# Altium schematic sheet GridSeed Old.SchDoc (part 1 of 2)
size A0
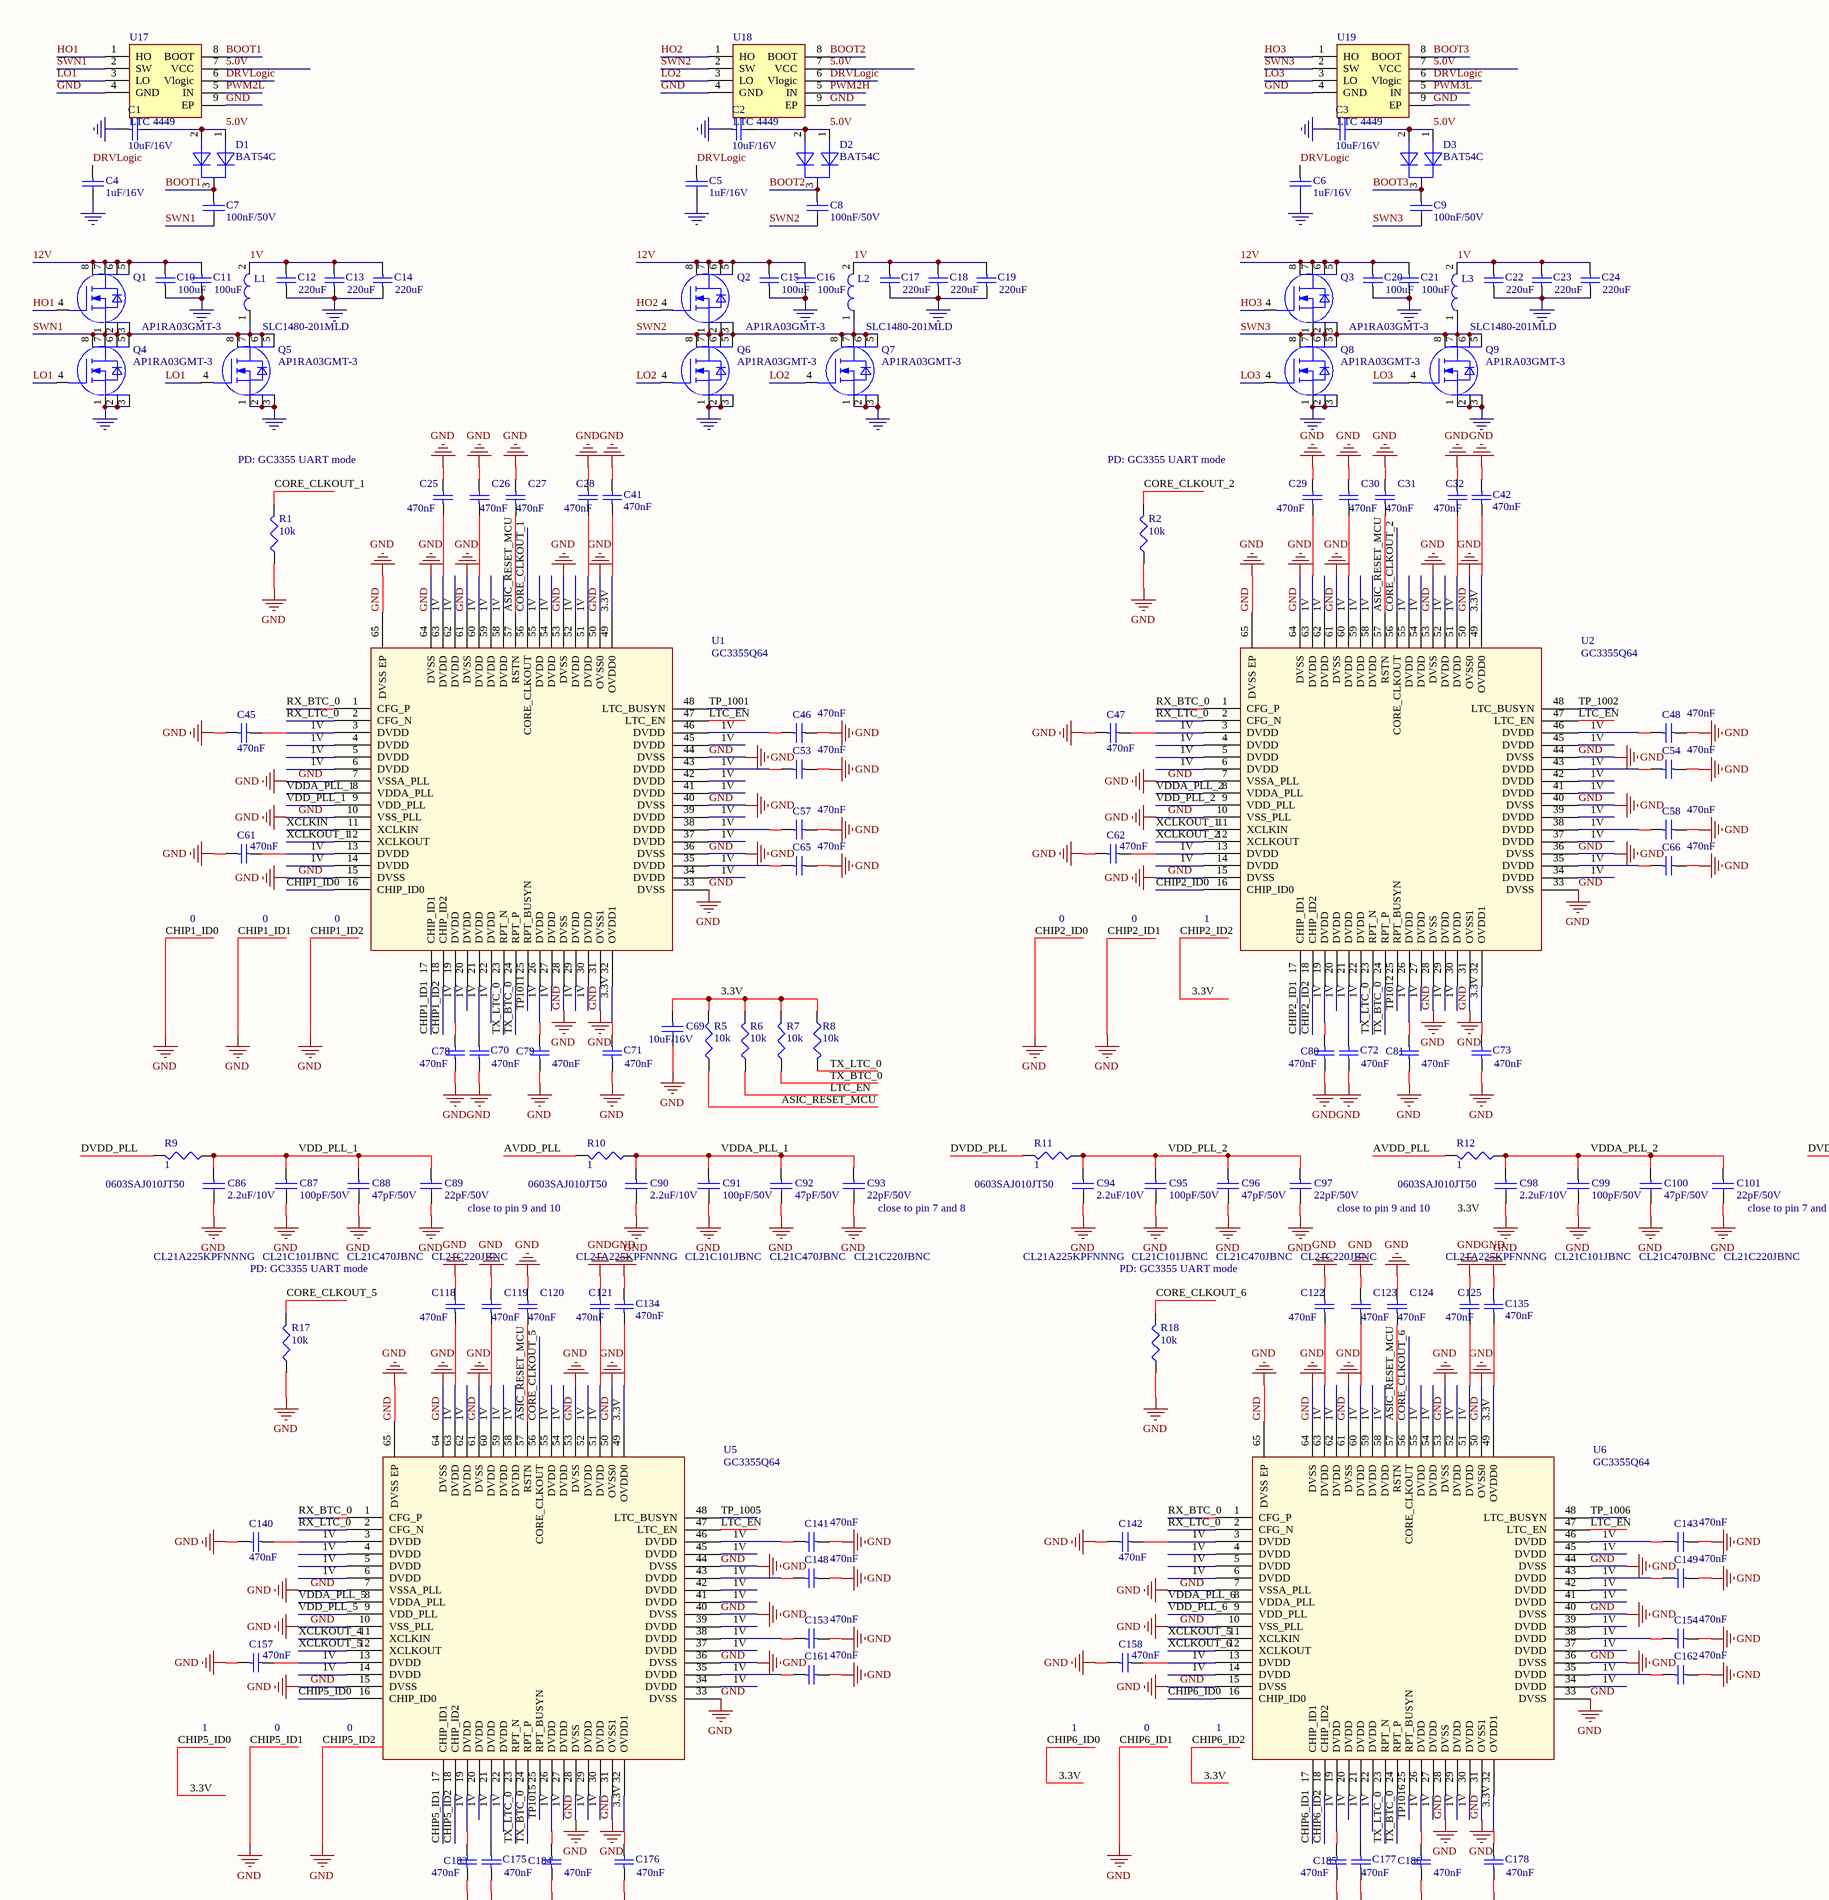
[diagram p0: GridSeed Old.SchDoc, top left]
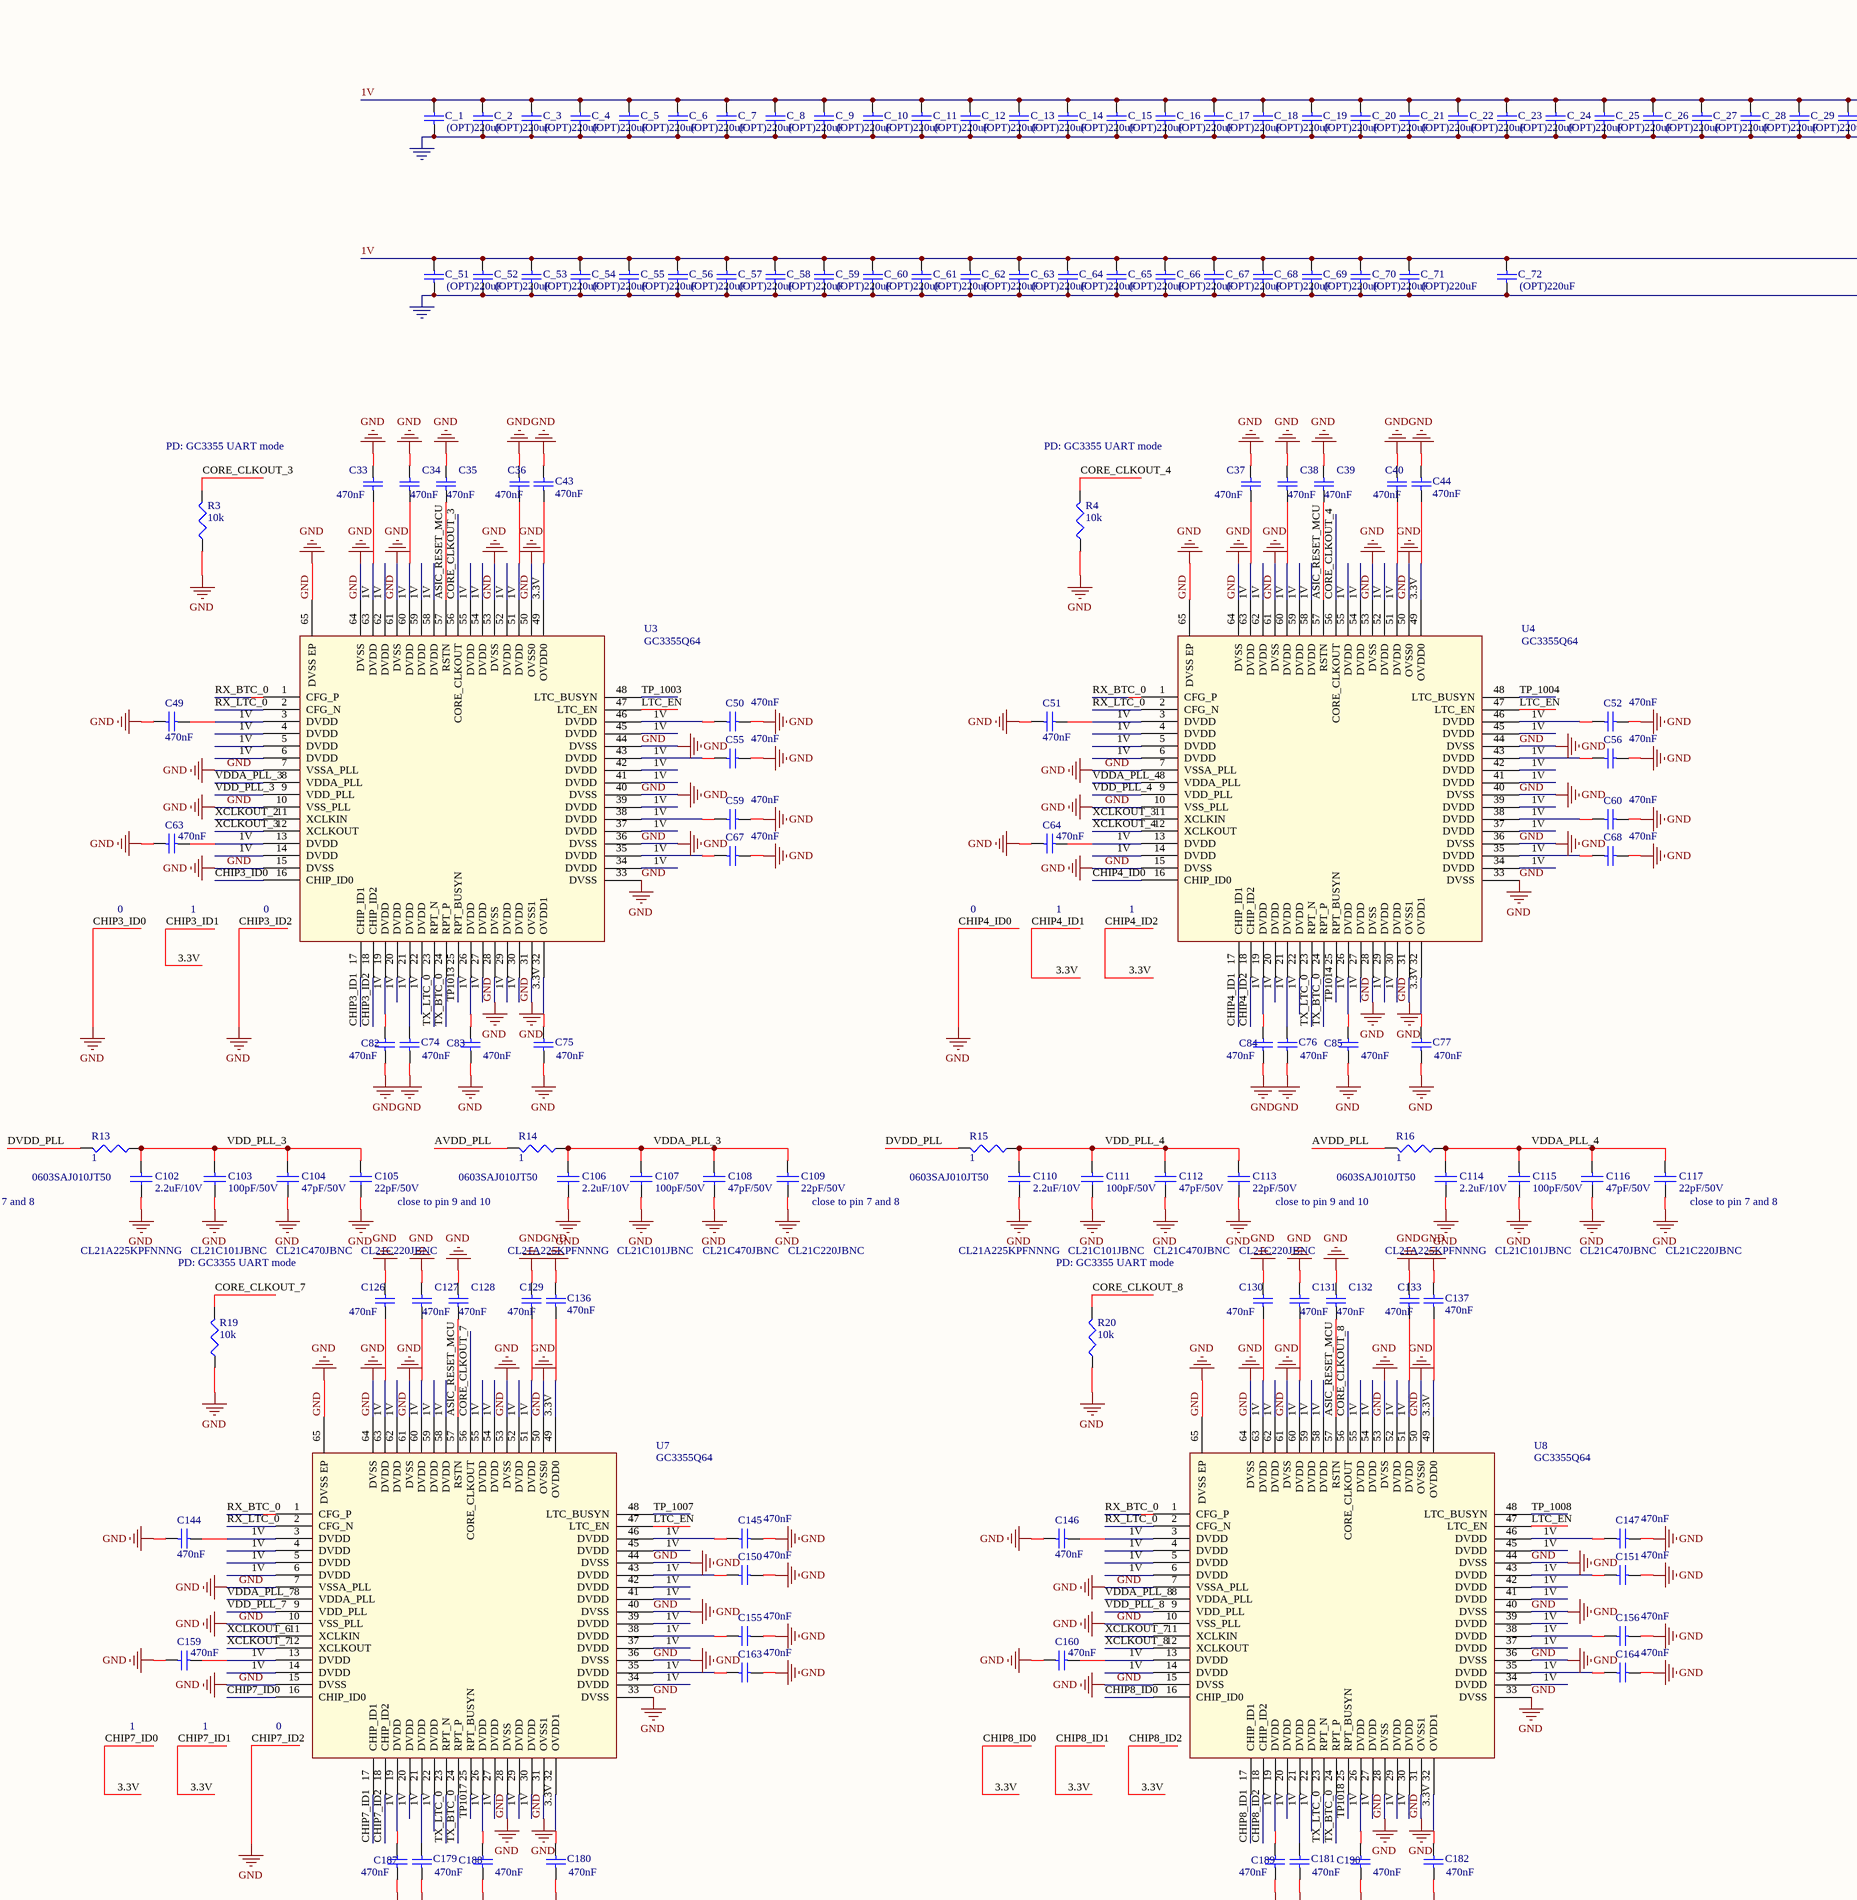
[diagram p1: GridSeed Old.SchDoc, top middle]
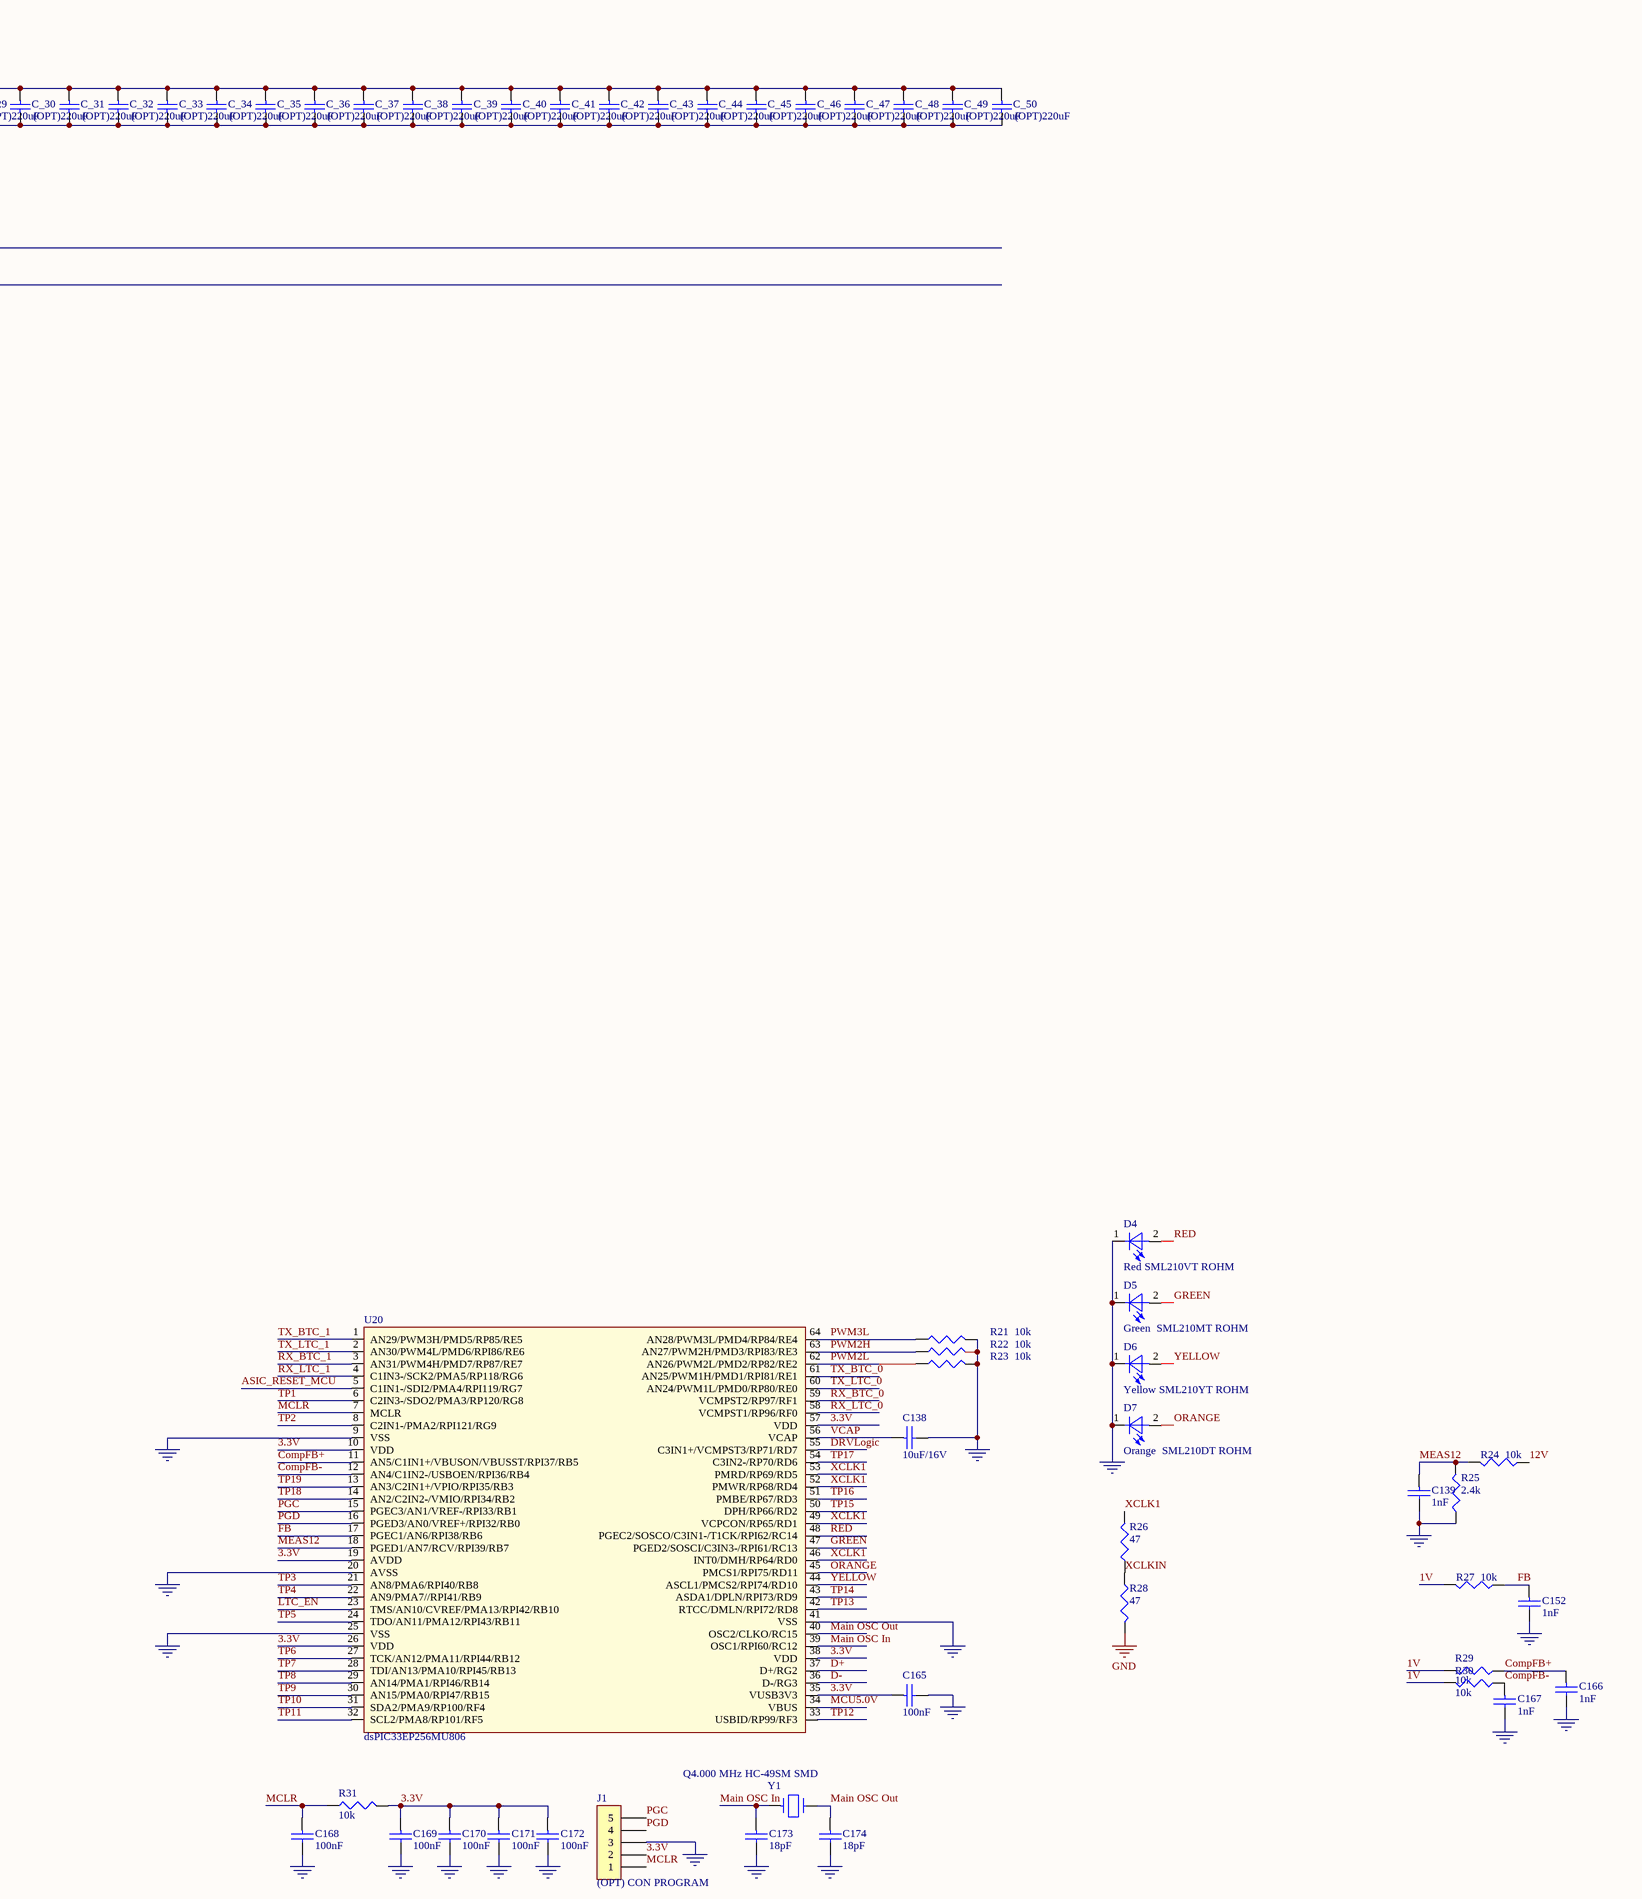
[diagram p2: GridSeed Old.SchDoc, top right]
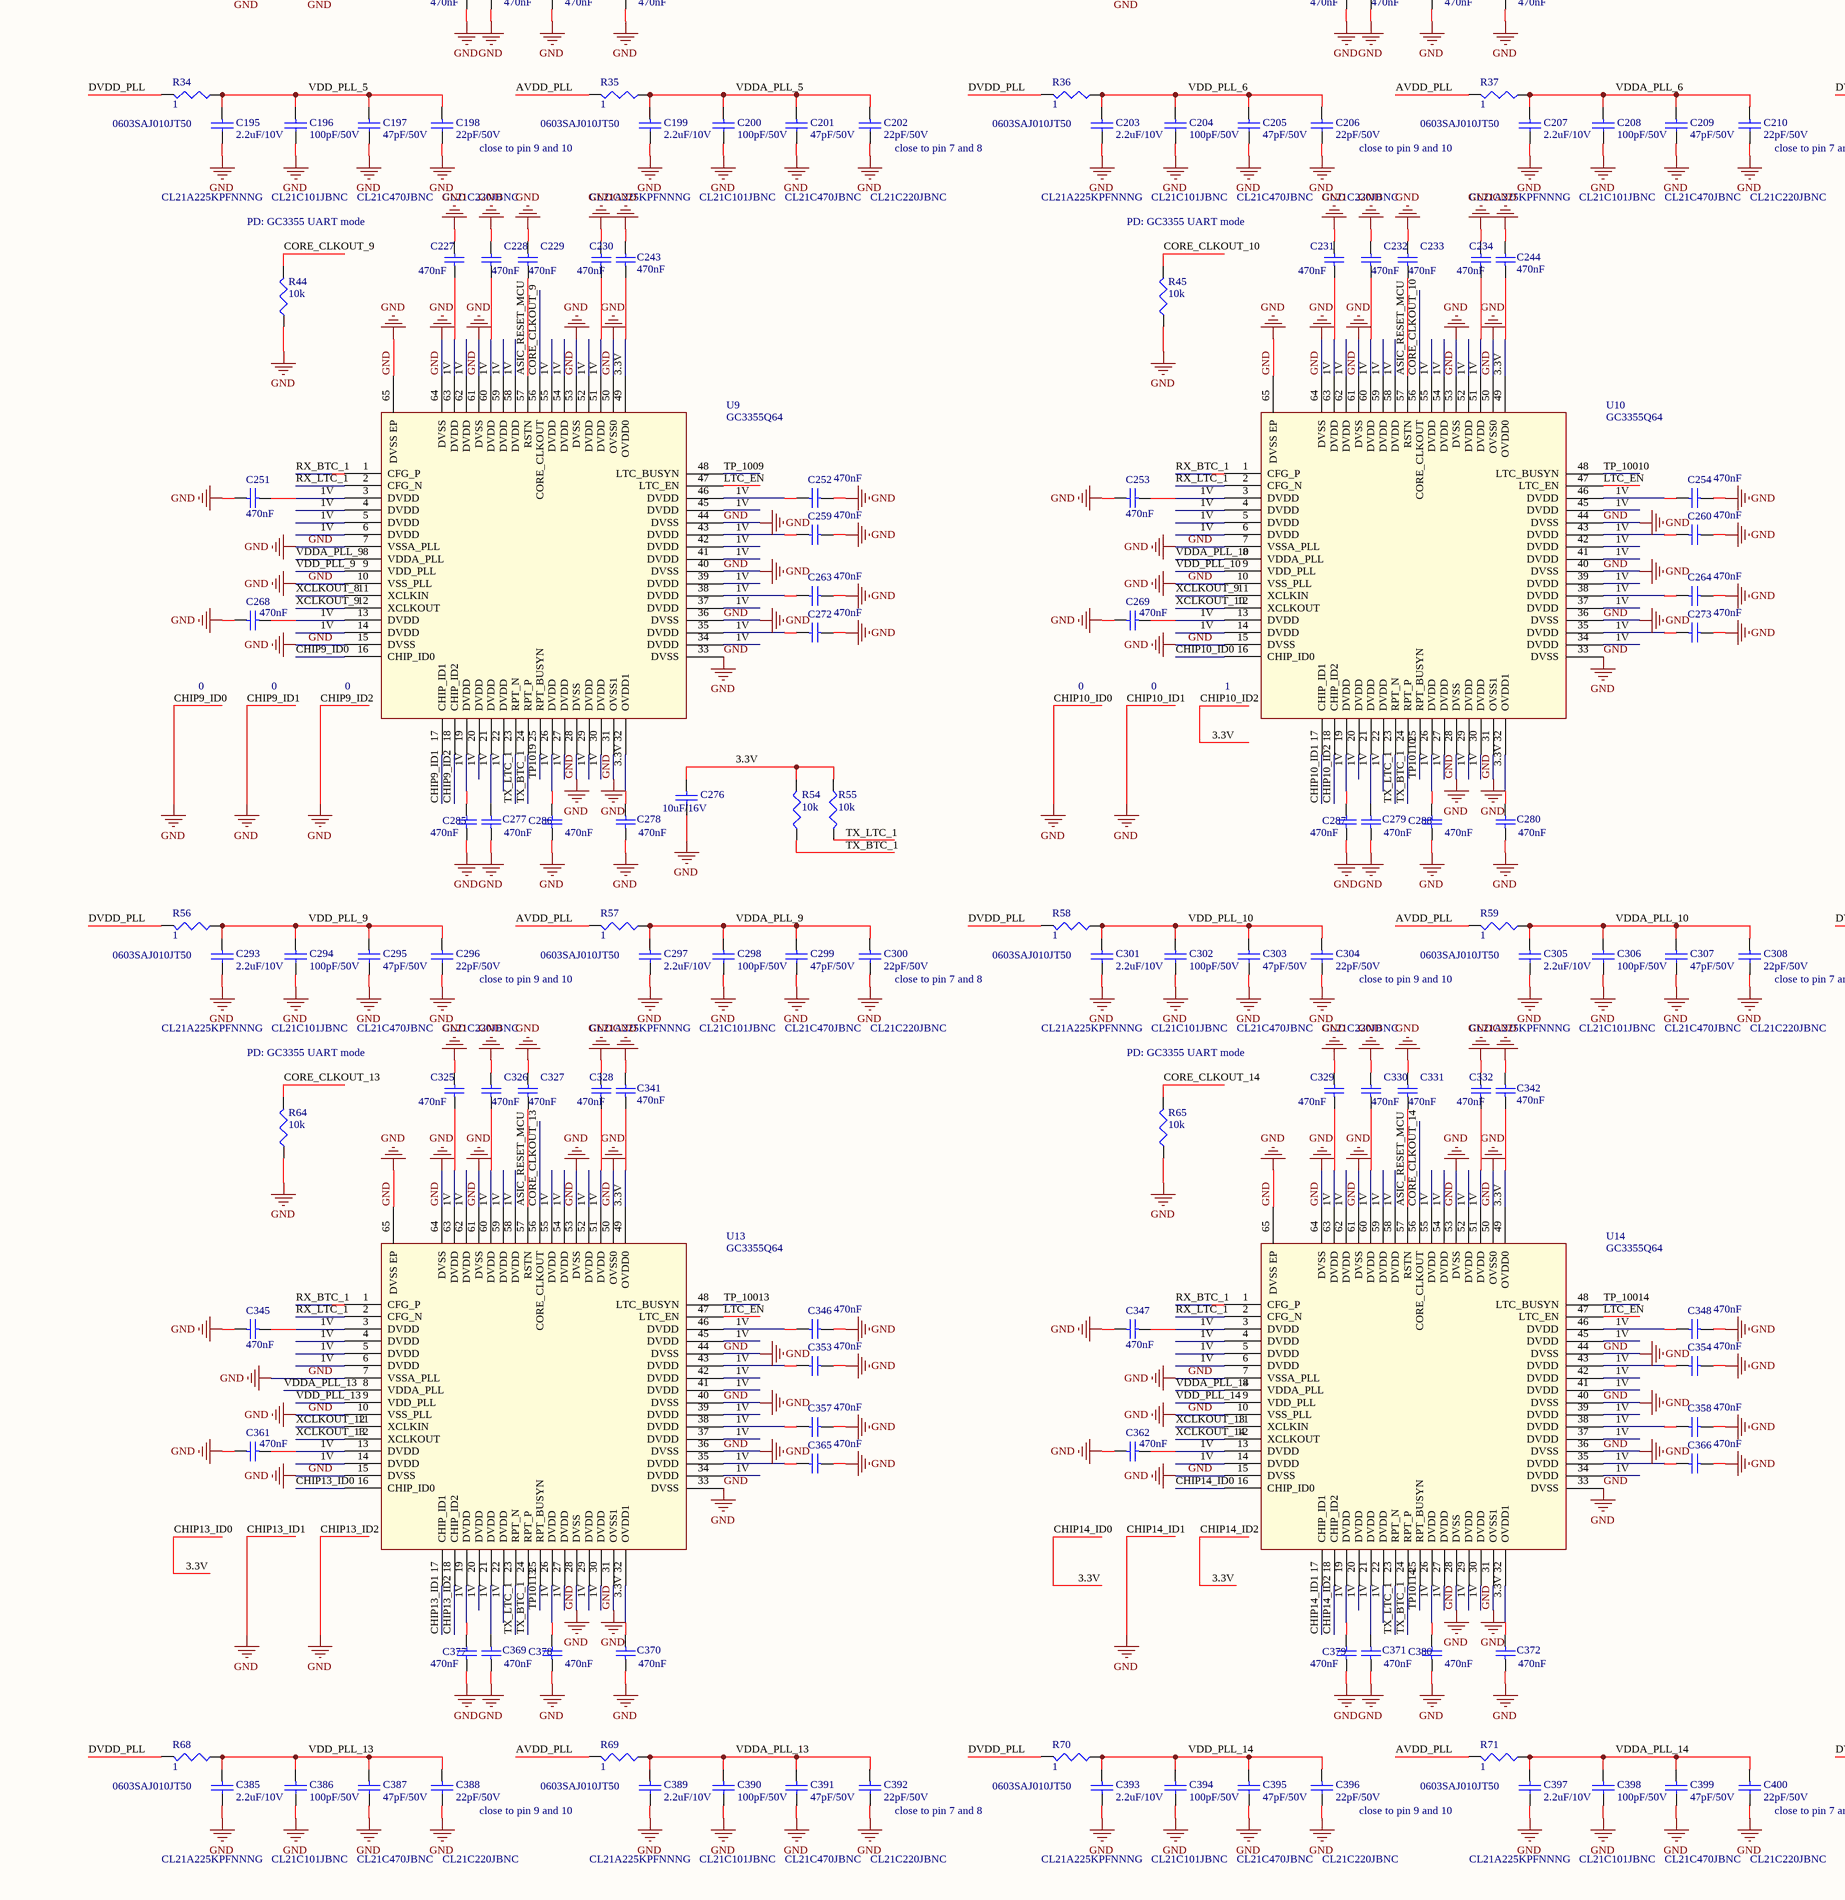
[diagram p3: GridSeed Old.SchDoc, bottom left]